# EasyEDA Pro project MushIO_V1p0_Final.eprj, board 4chAFE
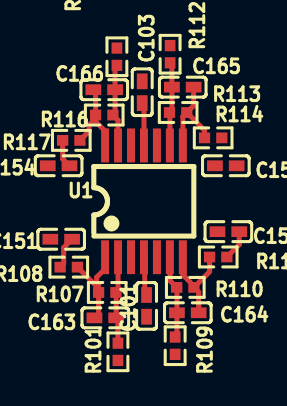
[diagram p11: board, top side]
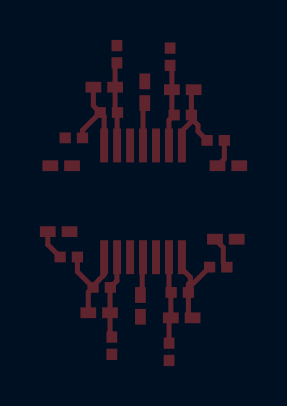
[diagram p12: board, bottom side, seen from below]

No outline. copper layers: Top Layer, Bottom Layer. Coordinates in mm from the lowest, leftmost part position.
Stack: Top Layer 0.035mm / Dielectric1 1.51mm FR4 er 4.5 / Bottom Layer 0.035mm

## Design rules (mm)
template: JLCPCB Capability(Two Layers Board)
spacing copperThickness1oz (default): track to track 0.102, other pairs 0.152 to 0.3
spacing copperThickness2oz: track to track 0.203, other pairs 0.152 to 0.3
track width copperThickness1oz (default): min 0.127, default 0.254, max 2.54
track width copperThickness2oz: min 0.203, default 0.254, max 2.54
differential pair differentialPair (default): width min 0.127, default 0.254, max 2.54; gap min 0.152, default 0.152
via viaSize (default): diameter min 0.5, default 0.61, max 10; hole min 0.3, default 0.305, max 6.3

## Placement (name value [footprint] x y rotation side)
C101  100nF  [C0402]  4.41 2.3 270 top
C103  100nF  [C0402]  4.19 13.01 90 top
C151  680nF  [C0402]  0.13 5.64 0 top
C152  680nF  [C0402]  8.51 6.02 0 top
C153  680nF  [C0402]  8.38 9.32 0 top
C154  680nF  [C0402]  0 9.32 0 top
C163  68nF  [C0402]  2.34 1.7 180 top
C164  68nF  [C0402]  6.48 1.96 0 top
C165  68nF  [C0402]  6.22 13.26 0 top
C166  68nF  [C0402]  2.29 13.13 180 top
R101  510Ω  [R0402]  2.97 0 90 top
R107  5.1kΩ  [R0402]  2.44 2.97 180 top
R108  510Ω  [R0402]  0.51 4.24 180 top
R109  510Ω  [R0402]  5.84 0.31 90 top
R110  5.1kΩ  [R0402]  6.35 3.23 0 top
R111  510Ω  [R0402]  8 4.75 0 top
R112  510Ω  [R0402]  5.59 14.91 270 top
R113  5.1kΩ  [R0402]  5.99 11.99 0 top
R114  510Ω  [R0402]  7.75 10.72 0 top
R115  510Ω  [R0402]  2.92 14.78 270 top
R116  5.1kΩ  [R0402]  2.29 11.86 180 top
R117  510Ω  [R0402]  0.63 10.59 180 top
U1  TLV4387PWR  [TSSOP-14_L5.0-W4.4-P0.65-LS6.4-BL]  4.28 7.54 0 top

## Footprints (pads in the part's own frame, mm; a bottom-side part is the same pattern mirrored in y, then rotated)
C0402
  rect 0.79x0.54 smd: 1(-0.545,0) 2(0.545,0)
R0402
  rect 0.566x0.54 smd: 1(-0.433,0) 2(0.433,0)
TSSOP-14_L5.0-W4.4-P0.65-LS6.4-BL
  rect 0.4x1.7 smd: 1(-1.95,-2.8) 2(-1.3,-2.8) 3(-0.65,-2.8) 4(0,-2.8) 5(0.65,-2.8) 6(1.3,-2.8) 7(1.95,-2.8) 8(1.95,2.8) 9(1.3,2.8) 10(0.65,2.8) 11(0,2.8) 12(-0.65,2.8) 13(-1.3,2.8) 14(-1.95,2.8)

## Nets
As in the schematic.

## Routing (per net, layer and track width the routed paths; a pad name or vN(x,y) marks a point on that pad's centre or on a via; arc(x,y) is an arc through that point)
AVDD_2V5: length 2.1
  Top Layer w0.254: U1.4 4.32,4.7 4.32,2.63
AVSS_N2V5: length 1.9
  Top Layer w0.254: U1.11 4.28,12.12 4.19,12.21
VFB1: length 4.4
  Top Layer w0.254: R101.2 2.97,1.61 C163.1 2.88,2.96 2.87,2.97 2.98,3.08 U1.2
VFB2: length 4.2
  Top Layer w0.254: U1.6 5.59,4.73 5.59,3.56 R110.1 5.93,3.21 C164.1 5.93,0.83 R109.2
VFB3: length 4.2
  Top Layer w0.254: U1.9 5.58,11.97 R113.1 5.68,12.11 C165.1 5.68,14.39 R112.2
VFB4: length 4.2
  Top Layer w0.254: U1.13 2.98,11.6 R116.1 2.83,11.98 C166.1 2.83,14.26 R115.2
VOUT_W: length 1.6
  Top Layer w0.254: C151.2 0.25,5.22 0.25,4.42 R108.2
VOUT_X: length 1.5
  Top Layer w0.254: C152.2 9.05,5.37 R111.2
VOUT_Z: length 1.4
  Top Layer w0.254: C154.2 0.2,9.67 R117.2
$3N2543: length 4.8
  Top Layer w0.254: 2,3.18 R108.1 ; 2,3.18 2,3.38 1.91,3.48 1.91,3.73 2.33,4.16 U1.1 ; 2,3.18 R107.2 2,1.91 C163.2
$3N3156: length 4.6
  Top Layer w0.254: 6.6,3.48 6.48,3.61 6.48,3.61 6.32,3.78 6.31,3.78 6.23,3.86 U1.7 ; C164.2 7.02,2.99 R110.2 7.57,4.01 R111.1
$3N3675: length 4.8
  Top Layer w0.254: 6.42,11.99 6.23,11.79 U1.8 ; 6.42,11.99 7.31,11.1 R114.1 ; 6.42,11.99 6.77,12.33 C165.2
$3N3903: length 4.5
  Top Layer w0.254: 1.85,11.68 1.85,11.53 2.33,11.06 U1.14 ; 1.85,11.68 1.52,11.36 1.52,11.05 R117.1 ; 1.85,11.68 1.85,13.02 1.74,13.13
